# EasyEDA Pro project BLDCv5.eprj, board PCB4_1
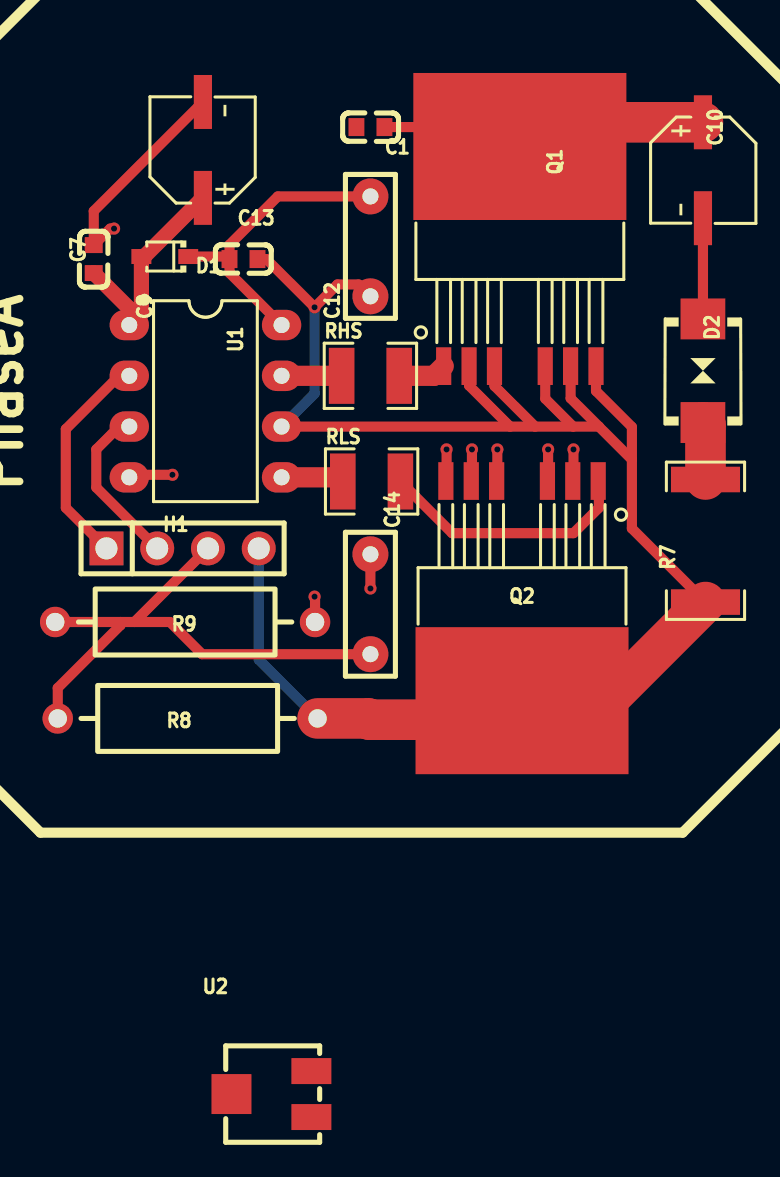
[diagram p10: board, top side]
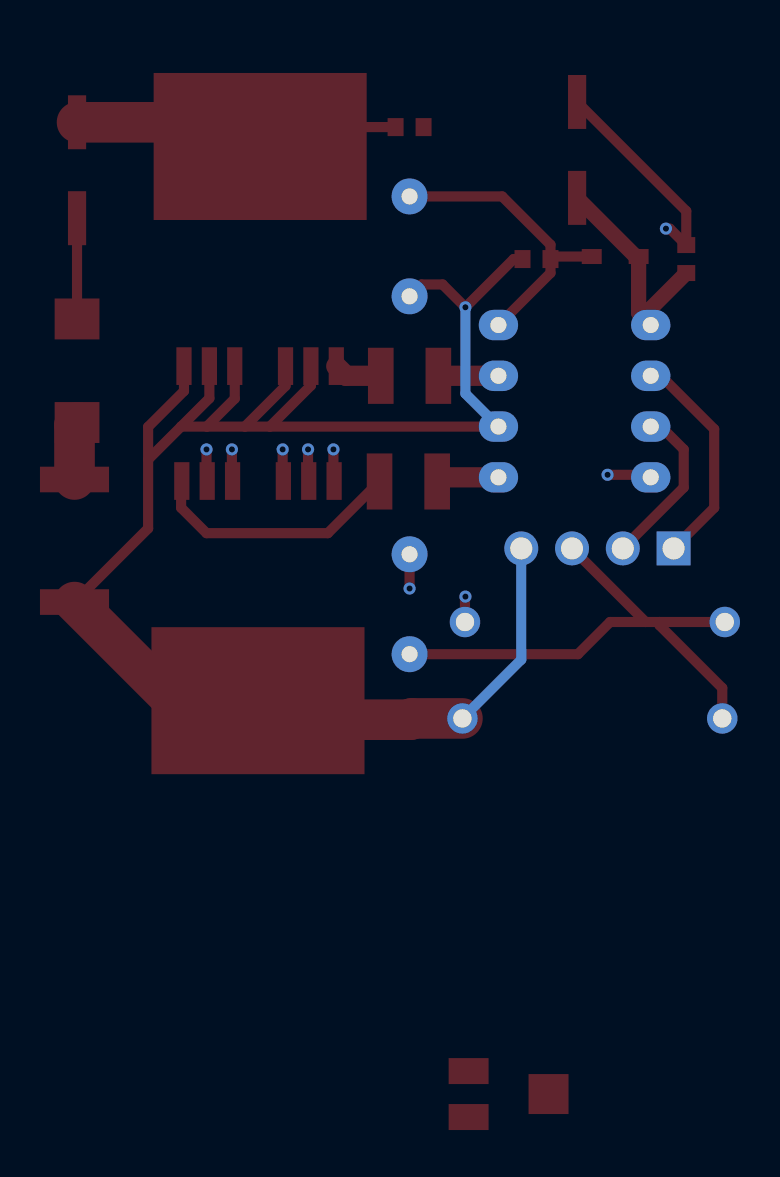
[diagram p11: board, bottom side, seen from below]

No outline. copper layers: Top Layer, Bottom Layer. Coordinates in mm from the lowest, leftmost part position.
Stack: Top Layer 0.035mm / Dielectric1 1.51mm FR4 er 4.5 / Bottom Layer 0.035mm

## Design rules (mm)
template: JLCPCB Capability(Two Layers Board)
spacing copperThickness1oz (default): track to track 0.102, other pairs 0.152 to 0.3
spacing copperThickness2oz: track to track 0.203, other pairs 0.152 to 0.3
track width copperThickness1oz (default): min 0.127, default 0.254, max 2.54
track width copperThickness2oz: min 0.203, default 0.254, max 2.54
differential pair differentialPair (default): width min 0.127, default 0.254, max 2.54; gap min 0.152, default 0.152
via viaSize (default): diameter min 0.5, default 0.61, max 10; hole min 0.3, default 0.305, max 6.3

## Placement (name value [footprint] x y rotation side)
C1  100nF  [C0603]  13.84 48.39 180 top
C7  100nF  [C0603]  0 41.78 90 top
C9  10uF  [CAP-SMD_BD5.0-L5.3-W5.3-LS6.3-FD]  5.46 47.24 90 top
C10  10uF  [CAP-SMD_BD5.0-L5.3-W5.3-LS6.3-FD]  30.48 46.23 270 top
C12  1uF  [CAP-TH_L7.2-W2.5-P5.00-D0.6]  13.84 42.42 90 top
C13  100nF  [C0603]  7.49 41.78 0 top
C14  1uF  [CAP-TH_L7.2-W2.5-P5.00-D0.6]  13.84 24.51 270 top
D1  1N5819WS  [SOD-323_L1.8-W1.3-LS2.5-RD]  3.56 41.91 180 top
D2  P6SMB6.8CA/TR13  [SMB_L4.6-W3.6-LS5.3-BI]  30.48 36.19 270 top
H1  -  [HDR-TH_4P-P2.54-V-M]  4.44 27.3 0 top
Q1  IRF2804STRL7PP  [D2PAK-7_L10.6-W9.6-P1.27-LS15.9-BR]  21.32 41.92 270 top
Q2  IRF2804STRL7PP  [D2PAK-7_L10.6-W9.6-P1.27-LS15.9-BR]  21.43 25.18 90 top
R7  5mΩ  [R2512]  30.61 27.69 90 top
R8  10kΩ  [RES-TH_BD3.3-L9.0-P13.00-D0.6]  4.7 18.8 0 top
R9  10kΩ  [RES-TH_BD3.3-L9.0-P13.00-D0.6]  4.57 23.62 180 top
RHS  10  [R1210]  13.84 35.94 0 top
RLS  10  [R1210]  13.9 30.65 0 top
U1  IR2104PBF  [DIP-8_L9.9-W6.6-P2.54-LS7.62-BL]  5.59 34.67 270 top
U2  3224J-1-501E  [RES-ADJ-SMD_3P-L4.8-W4.6-P2.30-TR]  8.89 0 0 top

## Footprints (pads in the part's own frame, mm; a bottom-side part is the same pattern mirrored in y, then rotated)
C0603
  rect 0.8x0.9 smd: 1(-0.7,0) 2(0.7,0)
CAP-SMD_BD5.0-L5.3-W5.3-LS6.3-FD
  rect 2.7x0.91 smd: 1(-2.4,0) 2(2.4,0)
CAP-TH_L7.2-W2.5-P5.00-D0.6
  round 1.8 hole 0.8: 1(-2.499,0) 2(2.499,0)
D2PAK-7_L10.6-W9.6-P1.27-LS15.9-BR
  rect 1.887x0.762 smd: 1(5.495,-3.81) 2(5.495,-2.54) 3(5.495,-1.27) 5(5.495,1.27) 6(5.495,2.54) 7(5.495,3.81)
  rect 7.356x10.66 smd: 4(-5.495,0)
DIP-8_L9.9-W6.6-P2.54-LS7.62-BL
  oval 1.524x1.97 hole 0.8: 1(-3.81,-3.81) 2(-1.27,-3.81) 3(1.27,-3.81) 4(3.81,-3.81) 5(3.81,3.81) 6(1.27,3.81) 7(-1.27,3.81) 8(-3.81,3.81)
HDR-TH_4P-P2.54-V-M
  rect 1.7x1.7 hole 1.1: 1(-3.81,0)
  round 1.7 hole 1.1: 2(-1.27,0) 3(1.27,0) 4(3.81,0)
R1210
  rect 1.282x2.808 smd: 1(-1.441,0) 2(1.441,0)
R2512
  rect 1.282x3.456 smd: 1(-3.067,0) 2(3.067,0)
RES-ADJ-SMD_3P-L4.8-W4.6-P2.30-TR
  rect 2x1.3 smd: 1(2,1.15) 3(2,-1.15)
  rect 2x2 smd: 2(-2,0)
RES-TH_BD3.3-L9.0-P13.00-D0.6
  round 1.524 hole 0.914: 1(-6.5,0) 2(6.5,0)
SMB_L4.6-W3.6-LS5.3-BI
  rect 2.047x2.241 smd: 1(-2.591,0) 2(2.591,0)
SOD-323_L1.8-W1.3-LS2.5-RD
  rect 1x0.75 smd: 1(-1.173,0) 2(1.173,0)

## Nets
As in the schematic.

Pads without a net: U2 1 2 3

## Via types
v1: diameter 0.61, hole 0.305, Top Layer to Bottom Layer, 10 vias

## Routing (per net, layer and track width the routed paths; a pad name or vN(x,y) marks a point on that pad's centre or on a via; arc(x,y) is an arc through that point)
GND: length 29
  Top Layer w0.508: v1(17.65,32.26) 17.65,30.71 Q2.7 ; Q2.6 18.92,30.71 v1(18.92,32.26) ; v1(22.73,32.26) 22.73,30.71 Q2.3 ; v1(13.84,25.3) C14.1 ; R9.1 11.07,24.87 v1(11.05,24.89) ; v1(24,32.26) 24,30.71 Q2.2 ; v1(3.94,30.99) 1.91,30.99 U1.4 ; D2.1 C10.2 ; Q2.5 20.19,30.71 v1(20.19,32.26) ; C9.2 0,44.18 C7.2 0.82,43.31 v1(1.02,43.31)
VCC: length 11.3
  Top Layer w0.762: C7.1 1.78,39.3 U1.1 2.38,39.09 D1.2 2.53,41.91 C9.1
HI_IN: length 11.1
  Top Layer w0.508: U1.2 1.27,35.94 -1.4,33.27 -1.4,29.34 H1.1
ISENSE: length 93.4
  Top Layer w0.508: 23.99,33.4 25.27,33.4 ; 23.99,33.4 22.59,34.8 Q1.5 ; 23.99,33.4 22.08,33.4 ; 25.27,33.4 23.86,34.81 Q1.6 ; 25.27,33.4 26.92,31.75 ; Q1.7 25.13,35.18 26.92,33.38 26.92,31.75 ; 26.92,31.75 26.92,28.3 R7.1 30.61,25.13 ; 22.08,33.4 20.05,35.43 Q1.3 ; 22.08,33.4 20.83,33.4 ; C13.2 8.64,41.78 v1(11.05,39.37) 12.19,40.51 13.25,40.51 C12.1 ; 20.83,33.4 18.78,35.45 Q1.2 ; 20.83,33.4 U1.6
  Top Layer w2.032: R7.1 25.67,19.68 Q2.4 20.48,18.73 13.8,18.73 13.74,18.8 R8.2
  Bottom Layer w0.508: R8.2 8.25,21.74 H1.4 ; U1.6 11.05,35.05 v1(11.05,39.37)
PHASE_OUT: length 2.9
  Top Layer w2.032: D2.2 30.61,33.48 R7.2
POWER: length 16.8
  Top Layer w0.508: Q1.4 20.35,48.39 C1.1
  Top Layer w2.032: Q1.4 22.53,48.63 C10.1
SD#: length 8.3
  Top Layer w0.508: H1.2 0.13,30.35 0.13,32.26 1.27,33.4 U1.3
VSENSE: length 27.3
  Top Layer w0.508: 2.03,23.62 H1.3 ; 2.03,23.62 3.81,23.62 5.42,22.01 C14.2 ; 2.03,23.62 1.34,23.62 ; 1.34,23.62 1.34,23.46 -1.8,20.32 -1.8,19.3 ; 1.34,23.62 R9.2
$1N697: length 3
  Top Layer w1.016: U1.7 RHS.1
$1N698: length 2.4
  Top Layer w1.016: Q1.1 17.03,35.94 RHS.2
$1N699: length 3.1
  Top Layer w1.016: U1.5 12.25,30.86 RLS.1
$1N700: length 12.9
  Top Layer w0.508: Q2.1 25.27,30.64 25.27,29.34 24,28.07 17.93,28.07 RLS.2
$1N2600: length 15.3
  Top Layer w0.508: C12.2 9.21,44.92 6.79,42.5 C13.1 ; C13.1 6.67,41.91 D1.1 ; C13.1 6.79,41.09 U1.8

## Text on the board
Top Silkscreen Layer: PhaseA
